# EAGLE board Resistor_Resistor (EAGLE 8.3.0), part 31 of 32
## Placement (x,y rotation side) (continued)
R37923  10K  [0201]  255.78,75.64 0 top
R37924  10K  [0201]  255.78,76.25 0 top
R37925  10K  [0201]  255.78,76.86 0 top
R37926  10K  [0201]  255.78,77.47 0 top
R37927  10K  [0201]  255.78,78.08 0 top
R37928  10K  [0201]  255.78,78.69 0 top
R37929  10K  [0201]  255.78,79.3 0 top
R37930  10K  [0201]  255.78,79.91 0 top
R37931  10K  [0201]  255.78,80.52 0 top
R37932  10K  [0201]  255.78,81.13 0 top
R37933  10K  [0201]  255.78,81.74 0 top
R37934  10K  [0201]  255.78,82.35 0 top
R37935  10K  [0201]  255.78,82.96 0 top
R37936  10K  [0201]  255.78,83.57 0 top
R37937  10K  [0201]  255.78,84.18 0 top
R37938  10K  [0201]  255.78,84.79 0 top
R37939  10K  [0201]  255.78,85.39 0 top
R37940  10K  [0201]  255.78,86 0 top
R37941  10K  [0201]  255.78,86.61 0 top
R37942  10K  [0201]  255.78,87.22 0 top
R37943  10K  [0201]  255.78,87.83 0 top
R37944  10K  [0201]  255.78,88.44 0 top
R37945  10K  [0201]  255.78,89.05 0 top
R37946  10K  [0201]  255.78,89.66 0 top
R37947  10K  [0201]  255.78,90.27 0 top
R37948  10K  [0201]  255.78,90.88 0 top
R37949  10K  [0201]  255.78,91.49 0 top
R37950  10K  [0201]  255.78,92.1 0 top
R37951  10K  [0201]  255.78,92.71 0 top
R37952  10K  [0201]  255.78,93.32 0 top
R37953  10K  [0201]  255.78,93.93 0 top
R37954  10K  [0201]  255.78,94.54 0 top
R37955  10K  [0201]  255.78,95.15 0 top
R37956  10K  [0201]  255.78,95.76 0 top
R37957  10K  [0201]  255.78,96.37 0 top
R37958  10K  [0201]  255.78,96.98 0 top
R37959  10K  [0201]  255.78,97.59 0 top
R37960  10K  [0201]  255.78,98.2 0 top
R37961  10K  [0201]  255.78,98.81 0 top
R37962  10K  [0201]  255.78,99.42 0 top
R37963  10K  [0201]  255.78,100.03 0 top
R37964  10K  [0201]  255.78,100.63 0 top
R37965  10K  [0201]  255.78,101.24 0 top
R37966  10K  [0201]  255.78,101.85 0 top
R37967  10K  [0201]  255.78,102.46 0 top
R37968  10K  [0201]  255.78,103.07 0 top
R37969  10K  [0201]  255.78,103.68 0 top
R37970  10K  [0201]  255.78,104.29 0 top
R37971  10K  [0201]  255.78,104.9 0 top
R37972  10K  [0201]  255.78,105.51 0 top
R37973  10K  [0201]  255.78,106.12 0 top
R37974  10K  [0201]  255.78,106.73 0 top
R37975  10K  [0201]  255.78,107.34 0 top
R37976  10K  [0201]  255.78,107.95 0 top
R37977  10K  [0201]  255.78,108.56 0 top
R37978  10K  [0201]  255.78,109.17 0 top
R37979  10K  [0201]  255.78,109.78 0 top
R37980  10K  [0201]  255.78,110.39 0 top
R37981  10K  [0201]  255.78,111 0 top
R37982  10K  [0201]  255.78,111.61 0 top
R37983  10K  [0201]  255.78,112.22 0 top
R37984  10K  [0201]  255.78,112.83 0 top
R37985  10K  [0201]  255.78,113.44 0 top
R37986  10K  [0201]  255.78,114.05 0 top
R37987  10K  [0201]  255.78,114.66 0 top
R37988  10K  [0201]  255.78,115.27 0 top
R37989  10K  [0201]  255.78,115.87 0 top
R37990  10K  [0201]  255.78,116.48 0 top
R37991  10K  [0201]  255.78,117.09 0 top
R37992  10K  [0201]  255.78,117.7 0 top
R37993  10K  [0201]  255.78,118.31 0 top
R37994  10K  [0201]  255.78,118.92 0 top
R37995  10K  [0201]  255.78,119.53 0 top
R37996  10K  [0201]  255.78,120.14 0 top
R37997  10K  [0201]  255.78,120.75 0 top
R37998  10K  [0201]  255.78,121.36 0 top
R37999  10K  [0201]  255.78,121.97 0 top
R38000  10K  [0201]  255.78,122.58 0 top
R38001  10K  [0201]  257,1.27 0 top
R38002  10K  [0201]  257,1.88 0 top
R38003  10K  [0201]  257,2.49 0 top
R38004  10K  [0201]  257,3.1 0 top
R38005  10K  [0201]  257,3.71 0 top
R38006  10K  [0201]  257,4.32 0 top
R38007  10K  [0201]  257,4.93 0 top
R38008  10K  [0201]  257,5.54 0 top
R38009  10K  [0201]  257,6.15 0 top
R38010  10K  [0201]  257,6.76 0 top
R38011  10K  [0201]  257,7.37 0 top
R38012  10K  [0201]  257,7.98 0 top
R38013  10K  [0201]  257,8.59 0 top
R38014  10K  [0201]  257,9.19 0 top
R38015  10K  [0201]  257,9.8 0 top
R38016  10K  [0201]  257,10.41 0 top
R38017  10K  [0201]  257,11.02 0 top
R38018  10K  [0201]  257,11.63 0 top
R38019  10K  [0201]  257,12.24 0 top
R38020  10K  [0201]  257,12.85 0 top
R38021  10K  [0201]  257,13.46 0 top
R38022  10K  [0201]  257,14.07 0 top
R38023  10K  [0201]  257,14.68 0 top
R38024  10K  [0201]  257,15.29 0 top
R38025  10K  [0201]  257,15.9 0 top
R38026  10K  [0201]  257,16.51 0 top
R38027  10K  [0201]  257,17.12 0 top
R38028  10K  [0201]  257,17.73 0 top
R38029  10K  [0201]  257,18.34 0 top
R38030  10K  [0201]  257,18.95 0 top
R38031  10K  [0201]  257,19.56 0 top
R38032  10K  [0201]  257,20.17 0 top
R38033  10K  [0201]  257,20.78 0 top
R38034  10K  [0201]  257,21.39 0 top
R38035  10K  [0201]  257,22 0 top
R38036  10K  [0201]  257,22.61 0 top
R38037  10K  [0201]  257,23.22 0 top
R38038  10K  [0201]  257,23.83 0 top
R38039  10K  [0201]  257,24.43 0 top
R38040  10K  [0201]  257,25.04 0 top
R38041  10K  [0201]  257,25.65 0 top
R38042  10K  [0201]  257,26.26 0 top
R38043  10K  [0201]  257,26.87 0 top
R38044  10K  [0201]  257,27.48 0 top
R38045  10K  [0201]  257,28.09 0 top
R38046  10K  [0201]  257,28.7 0 top
R38047  10K  [0201]  257,29.31 0 top
R38048  10K  [0201]  257,29.92 0 top
R38049  10K  [0201]  257,30.53 0 top
R38050  10K  [0201]  257,31.14 0 top
R38051  10K  [0201]  257,31.75 0 top
R38052  10K  [0201]  257,32.36 0 top
R38053  10K  [0201]  257,32.97 0 top
R38054  10K  [0201]  257,33.58 0 top
R38055  10K  [0201]  257,34.19 0 top
R38056  10K  [0201]  257,34.8 0 top
R38057  10K  [0201]  257,35.41 0 top
R38058  10K  [0201]  257,36.02 0 top
R38059  10K  [0201]  257,36.63 0 top
R38060  10K  [0201]  257,37.24 0 top
R38061  10K  [0201]  257,37.85 0 top
R38062  10K  [0201]  257,38.46 0 top
R38063  10K  [0201]  257,39.07 0 top
R38064  10K  [0201]  257,39.67 0 top
R38065  10K  [0201]  257,40.28 0 top
R38066  10K  [0201]  257,40.89 0 top
R38067  10K  [0201]  257,41.5 0 top
R38068  10K  [0201]  257,42.11 0 top
R38069  10K  [0201]  257,42.72 0 top
R38070  10K  [0201]  257,43.33 0 top
R38071  10K  [0201]  257,43.94 0 top
R38072  10K  [0201]  257,44.55 0 top
R38073  10K  [0201]  257,45.16 0 top
R38074  10K  [0201]  257,45.77 0 top
R38075  10K  [0201]  257,46.38 0 top
R38076  10K  [0201]  257,46.99 0 top
R38077  10K  [0201]  257,47.6 0 top
R38078  10K  [0201]  257,48.21 0 top
R38079  10K  [0201]  257,48.82 0 top
R38080  10K  [0201]  257,49.43 0 top
R38081  10K  [0201]  257,50.04 0 top
R38082  10K  [0201]  257,50.65 0 top
R38083  10K  [0201]  257,51.26 0 top
R38084  10K  [0201]  257,51.87 0 top
R38085  10K  [0201]  257,52.48 0 top
R38086  10K  [0201]  257,53.09 0 top
R38087  10K  [0201]  257,53.7 0 top
R38088  10K  [0201]  257,54.31 0 top
R38089  10K  [0201]  257,54.91 0 top
R38090  10K  [0201]  257,55.52 0 top
R38091  10K  [0201]  257,56.13 0 top
R38092  10K  [0201]  257,56.74 0 top
R38093  10K  [0201]  257,57.35 0 top
R38094  10K  [0201]  257,57.96 0 top
R38095  10K  [0201]  257,58.57 0 top
R38096  10K  [0201]  257,59.18 0 top
R38097  10K  [0201]  257,59.79 0 top
R38098  10K  [0201]  257,60.4 0 top
R38099  10K  [0201]  257,61.01 0 top
R38100  10K  [0201]  257,61.62 0 top
R38101  10K  [0201]  257,62.23 0 top
R38102  10K  [0201]  257,62.84 0 top
R38103  10K  [0201]  257,63.45 0 top
R38104  10K  [0201]  257,64.06 0 top
R38105  10K  [0201]  257,64.67 0 top
R38106  10K  [0201]  257,65.28 0 top
R38107  10K  [0201]  257,65.89 0 top
R38108  10K  [0201]  257,66.5 0 top
R38109  10K  [0201]  257,67.11 0 top
R38110  10K  [0201]  257,67.72 0 top
R38111  10K  [0201]  257,68.33 0 top
R38112  10K  [0201]  257,68.94 0 top
R38113  10K  [0201]  257,69.55 0 top
R38114  10K  [0201]  257,70.15 0 top
R38115  10K  [0201]  257,70.76 0 top
R38116  10K  [0201]  257,71.37 0 top
R38117  10K  [0201]  257,71.98 0 top
R38118  10K  [0201]  257,72.59 0 top
R38119  10K  [0201]  257,73.2 0 top
R38120  10K  [0201]  257,73.81 0 top
R38121  10K  [0201]  257,74.42 0 top
R38122  10K  [0201]  257,75.03 0 top
R38123  10K  [0201]  257,75.64 0 top
R38124  10K  [0201]  257,76.25 0 top
R38125  10K  [0201]  257,76.86 0 top
R38126  10K  [0201]  257,77.47 0 top
R38127  10K  [0201]  257,78.08 0 top
R38128  10K  [0201]  257,78.69 0 top
R38129  10K  [0201]  257,79.3 0 top
R38130  10K  [0201]  257,79.91 0 top
R38131  10K  [0201]  257,80.52 0 top
R38132  10K  [0201]  257,81.13 0 top
R38133  10K  [0201]  257,81.74 0 top
R38134  10K  [0201]  257,82.35 0 top
R38135  10K  [0201]  257,82.96 0 top
R38136  10K  [0201]  257,83.57 0 top
R38137  10K  [0201]  257,84.18 0 top
R38138  10K  [0201]  257,84.79 0 top
R38139  10K  [0201]  257,85.39 0 top
R38140  10K  [0201]  257,86 0 top
R38141  10K  [0201]  257,86.61 0 top
R38142  10K  [0201]  257,87.22 0 top
R38143  10K  [0201]  257,87.83 0 top
R38144  10K  [0201]  257,88.44 0 top
R38145  10K  [0201]  257,89.05 0 top
R38146  10K  [0201]  257,89.66 0 top
R38147  10K  [0201]  257,90.27 0 top
R38148  10K  [0201]  257,90.88 0 top
R38149  10K  [0201]  257,91.49 0 top
R38150  10K  [0201]  257,92.1 0 top
R38151  10K  [0201]  257,92.71 0 top
R38152  10K  [0201]  257,93.32 0 top
R38153  10K  [0201]  257,93.93 0 top
R38154  10K  [0201]  257,94.54 0 top
R38155  10K  [0201]  257,95.15 0 top
R38156  10K  [0201]  257,95.76 0 top
R38157  10K  [0201]  257,96.37 0 top
R38158  10K  [0201]  257,96.98 0 top
R38159  10K  [0201]  257,97.59 0 top
R38160  10K  [0201]  257,98.2 0 top
R38161  10K  [0201]  257,98.81 0 top
R38162  10K  [0201]  257,99.42 0 top
R38163  10K  [0201]  257,100.03 0 top
R38164  10K  [0201]  257,100.63 0 top
R38165  10K  [0201]  257,101.24 0 top
R38166  10K  [0201]  257,101.85 0 top
R38167  10K  [0201]  257,102.46 0 top
R38168  10K  [0201]  257,103.07 0 top
R38169  10K  [0201]  257,103.68 0 top
R38170  10K  [0201]  257,104.29 0 top
R38171  10K  [0201]  257,104.9 0 top
R38172  10K  [0201]  257,105.51 0 top
R38173  10K  [0201]  257,106.12 0 top
R38174  10K  [0201]  257,106.73 0 top
R38175  10K  [0201]  257,107.34 0 top
R38176  10K  [0201]  257,107.95 0 top
R38177  10K  [0201]  257,108.56 0 top
R38178  10K  [0201]  257,109.17 0 top
R38179  10K  [0201]  257,109.78 0 top
R38180  10K  [0201]  257,110.39 0 top
R38181  10K  [0201]  257,111 0 top
R38182  10K  [0201]  257,111.61 0 top
R38183  10K  [0201]  257,112.22 0 top
R38184  10K  [0201]  257,112.83 0 top
R38185  10K  [0201]  257,113.44 0 top
R38186  10K  [0201]  257,114.05 0 top
R38187  10K  [0201]  257,114.66 0 top
R38188  10K  [0201]  257,115.27 0 top
R38189  10K  [0201]  257,115.87 0 top
R38190  10K  [0201]  257,116.48 0 top
R38191  10K  [0201]  257,117.09 0 top
R38192  10K  [0201]  257,117.7 0 top
R38193  10K  [0201]  257,118.31 0 top
R38194  10K  [0201]  257,118.92 0 top
R38195  10K  [0201]  257,119.53 0 top
R38196  10K  [0201]  257,120.14 0 top
R38197  10K  [0201]  257,120.75 0 top
R38198  10K  [0201]  257,121.36 0 top
R38199  10K  [0201]  257,121.97 0 top
R38200  10K  [0201]  257,122.58 0 top
R38201  10K  [0201]  258.22,1.27 0 top
R38202  10K  [0201]  258.22,1.88 0 top
R38203  10K  [0201]  258.22,2.49 0 top
R38204  10K  [0201]  258.22,3.1 0 top
R38205  10K  [0201]  258.22,3.71 0 top
R38206  10K  [0201]  258.22,4.32 0 top
R38207  10K  [0201]  258.22,4.93 0 top
R38208  10K  [0201]  258.22,5.54 0 top
R38209  10K  [0201]  258.22,6.15 0 top
R38210  10K  [0201]  258.22,6.76 0 top
R38211  10K  [0201]  258.22,7.37 0 top
R38212  10K  [0201]  258.22,7.98 0 top
R38213  10K  [0201]  258.22,8.59 0 top
R38214  10K  [0201]  258.22,9.19 0 top
R38215  10K  [0201]  258.22,9.8 0 top
R38216  10K  [0201]  258.22,10.41 0 top
R38217  10K  [0201]  258.22,11.02 0 top
R38218  10K  [0201]  258.22,11.63 0 top
R38219  10K  [0201]  258.22,12.24 0 top
R38220  10K  [0201]  258.22,12.85 0 top
R38221  10K  [0201]  258.22,13.46 0 top
R38222  10K  [0201]  258.22,14.07 0 top
R38223  10K  [0201]  258.22,14.68 0 top
R38224  10K  [0201]  258.22,15.29 0 top
R38225  10K  [0201]  258.22,15.9 0 top
R38226  10K  [0201]  258.22,16.51 0 top
R38227  10K  [0201]  258.22,17.12 0 top
R38228  10K  [0201]  258.22,17.73 0 top
R38229  10K  [0201]  258.22,18.34 0 top
R38230  10K  [0201]  258.22,18.95 0 top
R38231  10K  [0201]  258.22,19.56 0 top
R38232  10K  [0201]  258.22,20.17 0 top
R38233  10K  [0201]  258.22,20.78 0 top
R38234  10K  [0201]  258.22,21.39 0 top
R38235  10K  [0201]  258.22,22 0 top
R38236  10K  [0201]  258.22,22.61 0 top
R38237  10K  [0201]  258.22,23.22 0 top
R38238  10K  [0201]  258.22,23.83 0 top
R38239  10K  [0201]  258.22,24.43 0 top
R38240  10K  [0201]  258.22,25.04 0 top
R38241  10K  [0201]  258.22,25.65 0 top
R38242  10K  [0201]  258.22,26.26 0 top
R38243  10K  [0201]  258.22,26.87 0 top
R38244  10K  [0201]  258.22,27.48 0 top
R38245  10K  [0201]  258.22,28.09 0 top
R38246  10K  [0201]  258.22,28.7 0 top
R38247  10K  [0201]  258.22,29.31 0 top
R38248  10K  [0201]  258.22,29.92 0 top
R38249  10K  [0201]  258.22,30.53 0 top
R38250  10K  [0201]  258.22,31.14 0 top
R38251  10K  [0201]  258.22,31.75 0 top
R38252  10K  [0201]  258.22,32.36 0 top
R38253  10K  [0201]  258.22,32.97 0 top
R38254  10K  [0201]  258.22,33.58 0 top
R38255  10K  [0201]  258.22,34.19 0 top
R38256  10K  [0201]  258.22,34.8 0 top
R38257  10K  [0201]  258.22,35.41 0 top
R38258  10K  [0201]  258.22,36.02 0 top
R38259  10K  [0201]  258.22,36.63 0 top
R38260  10K  [0201]  258.22,37.24 0 top
R38261  10K  [0201]  258.22,37.85 0 top
R38262  10K  [0201]  258.22,38.46 0 top
R38263  10K  [0201]  258.22,39.07 0 top
R38264  10K  [0201]  258.22,39.67 0 top
R38265  10K  [0201]  258.22,40.28 0 top
R38266  10K  [0201]  258.22,40.89 0 top
R38267  10K  [0201]  258.22,41.5 0 top
R38268  10K  [0201]  258.22,42.11 0 top
R38269  10K  [0201]  258.22,42.72 0 top
R38270  10K  [0201]  258.22,43.33 0 top
R38271  10K  [0201]  258.22,43.94 0 top
R38272  10K  [0201]  258.22,44.55 0 top
R38273  10K  [0201]  258.22,45.16 0 top
R38274  10K  [0201]  258.22,45.77 0 top
R38275  10K  [0201]  258.22,46.38 0 top
R38276  10K  [0201]  258.22,46.99 0 top
R38277  10K  [0201]  258.22,47.6 0 top
R38278  10K  [0201]  258.22,48.21 0 top
R38279  10K  [0201]  258.22,48.82 0 top
R38280  10K  [0201]  258.22,49.43 0 top
R38281  10K  [0201]  258.22,50.04 0 top
R38282  10K  [0201]  258.22,50.65 0 top
R38283  10K  [0201]  258.22,51.26 0 top
R38284  10K  [0201]  258.22,51.87 0 top
R38285  10K  [0201]  258.22,52.48 0 top
R38286  10K  [0201]  258.22,53.09 0 top
R38287  10K  [0201]  258.22,53.7 0 top
R38288  10K  [0201]  258.22,54.31 0 top
R38289  10K  [0201]  258.22,54.91 0 top
R38290  10K  [0201]  258.22,55.52 0 top
R38291  10K  [0201]  258.22,56.13 0 top
R38292  10K  [0201]  258.22,56.74 0 top
R38293  10K  [0201]  258.22,57.35 0 top
R38294  10K  [0201]  258.22,57.96 0 top
R38295  10K  [0201]  258.22,58.57 0 top
R38296  10K  [0201]  258.22,59.18 0 top
R38297  10K  [0201]  258.22,59.79 0 top
R38298  10K  [0201]  258.22,60.4 0 top
R38299  10K  [0201]  258.22,61.01 0 top
R38300  10K  [0201]  258.22,61.62 0 top
R38301  10K  [0201]  258.22,62.23 0 top
R38302  10K  [0201]  258.22,62.84 0 top
R38303  10K  [0201]  258.22,63.45 0 top
R38304  10K  [0201]  258.22,64.06 0 top
R38305  10K  [0201]  258.22,64.67 0 top
R38306  10K  [0201]  258.22,65.28 0 top
R38307  10K  [0201]  258.22,65.89 0 top
R38308  10K  [0201]  258.22,66.5 0 top
R38309  10K  [0201]  258.22,67.11 0 top
R38310  10K  [0201]  258.22,67.72 0 top
R38311  10K  [0201]  258.22,68.33 0 top
R38312  10K  [0201]  258.22,68.94 0 top
R38313  10K  [0201]  258.22,69.55 0 top
R38314  10K  [0201]  258.22,70.15 0 top
R38315  10K  [0201]  258.22,70.76 0 top
R38316  10K  [0201]  258.22,71.37 0 top
R38317  10K  [0201]  258.22,71.98 0 top
R38318  10K  [0201]  258.22,72.59 0 top
R38319  10K  [0201]  258.22,73.2 0 top
R38320  10K  [0201]  258.22,73.81 0 top
R38321  10K  [0201]  258.22,74.42 0 top
R38322  10K  [0201]  258.22,75.03 0 top
R38323  10K  [0201]  258.22,75.64 0 top
R38324  10K  [0201]  258.22,76.25 0 top
R38325  10K  [0201]  258.22,76.86 0 top
R38326  10K  [0201]  258.22,77.47 0 top
R38327  10K  [0201]  258.22,78.08 0 top
R38328  10K  [0201]  258.22,78.69 0 top
R38329  10K  [0201]  258.22,79.3 0 top
R38330  10K  [0201]  258.22,79.91 0 top
R38331  10K  [0201]  258.22,80.52 0 top
R38332  10K  [0201]  258.22,81.13 0 top
R38333  10K  [0201]  258.22,81.74 0 top
R38334  10K  [0201]  258.22,82.35 0 top
R38335  10K  [0201]  258.22,82.96 0 top
R38336  10K  [0201]  258.22,83.57 0 top
R38337  10K  [0201]  258.22,84.18 0 top
R38338  10K  [0201]  258.22,84.79 0 top
R38339  10K  [0201]  258.22,85.39 0 top
R38340  10K  [0201]  258.22,86 0 top
R38341  10K  [0201]  258.22,86.61 0 top
R38342  10K  [0201]  258.22,87.22 0 top
R38343  10K  [0201]  258.22,87.83 0 top
R38344  10K  [0201]  258.22,88.44 0 top
R38345  10K  [0201]  258.22,89.05 0 top
R38346  10K  [0201]  258.22,89.66 0 top
R38347  10K  [0201]  258.22,90.27 0 top
R38348  10K  [0201]  258.22,90.88 0 top
R38349  10K  [0201]  258.22,91.49 0 top
R38350  10K  [0201]  258.22,92.1 0 top
R38351  10K  [0201]  258.22,92.71 0 top
R38352  10K  [0201]  258.22,93.32 0 top
R38353  10K  [0201]  258.22,93.93 0 top
R38354  10K  [0201]  258.22,94.54 0 top
R38355  10K  [0201]  258.22,95.15 0 top
R38356  10K  [0201]  258.22,95.76 0 top
R38357  10K  [0201]  258.22,96.37 0 top
R38358  10K  [0201]  258.22,96.98 0 top
R38359  10K  [0201]  258.22,97.59 0 top
R38360  10K  [0201]  258.22,98.2 0 top
R38361  10K  [0201]  258.22,98.81 0 top
R38362  10K  [0201]  258.22,99.42 0 top
R38363  10K  [0201]  258.22,100.03 0 top
R38364  10K  [0201]  258.22,100.63 0 top
R38365  10K  [0201]  258.22,101.24 0 top
R38366  10K  [0201]  258.22,101.85 0 top
R38367  10K  [0201]  258.22,102.46 0 top
R38368  10K  [0201]  258.22,103.07 0 top
R38369  10K  [0201]  258.22,103.68 0 top
R38370  10K  [0201]  258.22,104.29 0 top
R38371  10K  [0201]  258.22,104.9 0 top
R38372  10K  [0201]  258.22,105.51 0 top
R38373  10K  [0201]  258.22,106.12 0 top
R38374  10K  [0201]  258.22,106.73 0 top
R38375  10K  [0201]  258.22,107.34 0 top
R38376  10K  [0201]  258.22,107.95 0 top
R38377  10K  [0201]  258.22,108.56 0 top
R38378  10K  [0201]  258.22,109.17 0 top
R38379  10K  [0201]  258.22,109.78 0 top
R38380  10K  [0201]  258.22,110.39 0 top
R38381  10K  [0201]  258.22,111 0 top
R38382  10K  [0201]  258.22,111.61 0 top
R38383  10K  [0201]  258.22,112.22 0 top
R38384  10K  [0201]  258.22,112.83 0 top
R38385  10K  [0201]  258.22,113.44 0 top
R38386  10K  [0201]  258.22,114.05 0 top
R38387  10K  [0201]  258.22,114.66 0 top
R38388  10K  [0201]  258.22,115.27 0 top
R38389  10K  [0201]  258.22,115.87 0 top
R38390  10K  [0201]  258.22,116.48 0 top
R38391  10K  [0201]  258.22,117.09 0 top
R38392  10K  [0201]  258.22,117.7 0 top
R38393  10K  [0201]  258.22,118.31 0 top
R38394  10K  [0201]  258.22,118.92 0 top
R38395  10K  [0201]  258.22,119.53 0 top
R38396  10K  [0201]  258.22,120.14 0 top
R38397  10K  [0201]  258.22,120.75 0 top
R38398  10K  [0201]  258.22,121.36 0 top
R38399  10K  [0201]  258.22,121.97 0 top
R38400  10K  [0201]  258.22,122.58 0 top
R38401  10K  [0201]  259.44,1.27 0 top
R38402  10K  [0201]  259.44,1.88 0 top
R38403  10K  [0201]  259.44,2.49 0 top
R38404  10K  [0201]  259.44,3.1 0 top
R38405  10K  [0201]  259.44,3.71 0 top
R38406  10K  [0201]  259.44,4.32 0 top
R38407  10K  [0201]  259.44,4.93 0 top
R38408  10K  [0201]  259.44,5.54 0 top
R38409  10K  [0201]  259.44,6.15 0 top
R38410  10K  [0201]  259.44,6.76 0 top
R38411  10K  [0201]  259.44,7.37 0 top
R38412  10K  [0201]  259.44,7.98 0 top
R38413  10K  [0201]  259.44,8.59 0 top
R38414  10K  [0201]  259.44,9.19 0 top
R38415  10K  [0201]  259.44,9.8 0 top
R38416  10K  [0201]  259.44,10.41 0 top
R38417  10K  [0201]  259.44,11.02 0 top
R38418  10K  [0201]  259.44,11.63 0 top
R38419  10K  [0201]  259.44,12.24 0 top
R38420  10K  [0201]  259.44,12.85 0 top
R38421  10K  [0201]  259.44,13.46 0 top
R38422  10K  [0201]  259.44,14.07 0 top
R38423  10K  [0201]  259.44,14.68 0 top
R38424  10K  [0201]  259.44,15.29 0 top
R38425  10K  [0201]  259.44,15.9 0 top
R38426  10K  [0201]  259.44,16.51 0 top
R38427  10K  [0201]  259.44,17.12 0 top
R38428  10K  [0201]  259.44,17.73 0 top
R38429  10K  [0201]  259.44,18.34 0 top
R38430  10K  [0201]  259.44,18.95 0 top
R38431  10K  [0201]  259.44,19.56 0 top
R38432  10K  [0201]  259.44,20.17 0 top
R38433  10K  [0201]  259.44,20.78 0 top
R38434  10K  [0201]  259.44,21.39 0 top
R38435  10K  [0201]  259.44,22 0 top
R38436  10K  [0201]  259.44,22.61 0 top
R38437  10K  [0201]  259.44,23.22 0 top
R38438  10K  [0201]  259.44,23.83 0 top
R38439  10K  [0201]  259.44,24.43 0 top
R38440  10K  [0201]  259.44,25.04 0 top
R38441  10K  [0201]  259.44,25.65 0 top
R38442  10K  [0201]  259.44,26.26 0 top
R38443  10K  [0201]  259.44,26.87 0 top
R38444  10K  [0201]  259.44,27.48 0 top
R38445  10K  [0201]  259.44,28.09 0 top
R38446  10K  [0201]  259.44,28.7 0 top
R38447  10K  [0201]  259.44,29.31 0 top
R38448  10K  [0201]  259.44,29.92 0 top
R38449  10K  [0201]  259.44,30.53 0 top
R38450  10K  [0201]  259.44,31.14 0 top
R38451  10K  [0201]  259.44,31.75 0 top
R38452  10K  [0201]  259.44,32.36 0 top
R38453  10K  [0201]  259.44,32.97 0 top
R38454  10K  [0201]  259.44,33.58 0 top
R38455  10K  [0201]  259.44,34.19 0 top
R38456  10K  [0201]  259.44,34.8 0 top
R38457  10K  [0201]  259.44,35.41 0 top
R38458  10K  [0201]  259.44,36.02 0 top
R38459  10K  [0201]  259.44,36.63 0 top
R38460  10K  [0201]  259.44,37.24 0 top
R38461  10K  [0201]  259.44,37.85 0 top
R38462  10K  [0201]  259.44,38.46 0 top
R38463  10K  [0201]  259.44,39.07 0 top
R38464  10K  [0201]  259.44,39.67 0 top
R38465  10K  [0201]  259.44,40.28 0 top
R38466  10K  [0201]  259.44,40.89 0 top
R38467  10K  [0201]  259.44,41.5 0 top
R38468  10K  [0201]  259.44,42.11 0 top
R38469  10K  [0201]  259.44,42.72 0 top
R38470  10K  [0201]  259.44,43.33 0 top
R38471  10K  [0201]  259.44,43.94 0 top
R38472  10K  [0201]  259.44,44.55 0 top
R38473  10K  [0201]  259.44,45.16 0 top
R38474  10K  [0201]  259.44,45.77 0 top
R38475  10K  [0201]  259.44,46.38 0 top
R38476  10K  [0201]  259.44,46.99 0 top
R38477  10K  [0201]  259.44,47.6 0 top
R38478  10K  [0201]  259.44,48.21 0 top
R38479  10K  [0201]  259.44,48.82 0 top
R38480  10K  [0201]  259.44,49.43 0 top
R38481  10K  [0201]  259.44,50.04 0 top
R38482  10K  [0201]  259.44,50.65 0 top
R38483  10K  [0201]  259.44,51.26 0 top
R38484  10K  [0201]  259.44,51.87 0 top
R38485  10K  [0201]  259.44,52.48 0 top
R38486  10K  [0201]  259.44,53.09 0 top
R38487  10K  [0201]  259.44,53.7 0 top
R38488  10K  [0201]  259.44,54.31 0 top
R38489  10K  [0201]  259.44,54.91 0 top
R38490  10K  [0201]  259.44,55.52 0 top
R38491  10K  [0201]  259.44,56.13 0 top
R38492  10K  [0201]  259.44,56.74 0 top
R38493  10K  [0201]  259.44,57.35 0 top
R38494  10K  [0201]  259.44,57.96 0 top
R38495  10K  [0201]  259.44,58.57 0 top
R38496  10K  [0201]  259.44,59.18 0 top
R38497  10K  [0201]  259.44,59.79 0 top
R38498  10K  [0201]  259.44,60.4 0 top
R38499  10K  [0201]  259.44,61.01 0 top
R38500  10K  [0201]  259.44,61.62 0 top
R38501  10K  [0201]  259.44,62.23 0 top
R38502  10K  [0201]  259.44,62.84 0 top
R38503  10K  [0201]  259.44,63.45 0 top
R38504  10K  [0201]  259.44,64.06 0 top
R38505  10K  [0201]  259.44,64.67 0 top
R38506  10K  [0201]  259.44,65.28 0 top
R38507  10K  [0201]  259.44,65.89 0 top
R38508  10K  [0201]  259.44,66.5 0 top
R38509  10K  [0201]  259.44,67.11 0 top
R38510  10K  [0201]  259.44,67.72 0 top
R38511  10K  [0201]  259.44,68.33 0 top
R38512  10K  [0201]  259.44,68.94 0 top
R38513  10K  [0201]  259.44,69.55 0 top
R38514  10K  [0201]  259.44,70.15 0 top
R38515  10K  [0201]  259.44,70.76 0 top
R38516  10K  [0201]  259.44,71.37 0 top
R38517  10K  [0201]  259.44,71.98 0 top
R38518  10K  [0201]  259.44,72.59 0 top
R38519  10K  [0201]  259.44,73.2 0 top
R38520  10K  [0201]  259.44,73.81 0 top
R38521  10K  [0201]  259.44,74.42 0 top
R38522  10K  [0201]  259.44,75.03 0 top
R38523  10K  [0201]  259.44,75.64 0 top
R38524  10K  [0201]  259.44,76.25 0 top
R38525  10K  [0201]  259.44,76.86 0 top
R38526  10K  [0201]  259.44,77.47 0 top
R38527  10K  [0201]  259.44,78.08 0 top
R38528  10K  [0201]  259.44,78.69 0 top
R38529  10K  [0201]  259.44,79.3 0 top
R38530  10K  [0201]  259.44,79.91 0 top
R38531  10K  [0201]  259.44,80.52 0 top
R38532  10K  [0201]  259.44,81.13 0 top
R38533  10K  [0201]  259.44,81.74 0 top
R38534  10K  [0201]  259.44,82.35 0 top
R38535  10K  [0201]  259.44,82.96 0 top
R38536  10K  [0201]  259.44,83.57 0 top
R38537  10K  [0201]  259.44,84.18 0 top
R38538  10K  [0201]  259.44,84.79 0 top
R38539  10K  [0201]  259.44,85.39 0 top
R38540  10K  [0201]  259.44,86 0 top
R38541  10K  [0201]  259.44,86.61 0 top
R38542  10K  [0201]  259.44,87.22 0 top
R38543  10K  [0201]  259.44,87.83 0 top
R38544  10K  [0201]  259.44,88.44 0 top
R38545  10K  [0201]  259.44,89.05 0 top
R38546  10K  [0201]  259.44,89.66 0 top
R38547  10K  [0201]  259.44,90.27 0 top
R38548  10K  [0201]  259.44,90.88 0 top
R38549  10K  [0201]  259.44,91.49 0 top
R38550  10K  [0201]  259.44,92.1 0 top
R38551  10K  [0201]  259.44,92.71 0 top
R38552  10K  [0201]  259.44,93.32 0 top
R38553  10K  [0201]  259.44,93.93 0 top
R38554  10K  [0201]  259.44,94.54 0 top
R38555  10K  [0201]  259.44,95.15 0 top
R38556  10K  [0201]  259.44,95.76 0 top
R38557  10K  [0201]  259.44,96.37 0 top
R38558  10K  [0201]  259.44,96.98 0 top
R38559  10K  [0201]  259.44,97.59 0 top
R38560  10K  [0201]  259.44,98.2 0 top
R38561  10K  [0201]  259.44,98.81 0 top
R38562  10K  [0201]  259.44,99.42 0 top
R38563  10K  [0201]  259.44,100.03 0 top
R38564  10K  [0201]  259.44,100.63 0 top
R38565  10K  [0201]  259.44,101.24 0 top
R38566  10K  [0201]  259.44,101.85 0 top
R38567  10K  [0201]  259.44,102.46 0 top
R38568  10K  [0201]  259.44,103.07 0 top
R38569  10K  [0201]  259.44,103.68 0 top
R38570  10K  [0201]  259.44,104.29 0 top
R38571  10K  [0201]  259.44,104.9 0 top
R38572  10K  [0201]  259.44,105.51 0 top
R38573  10K  [0201]  259.44,106.12 0 top
R38574  10K  [0201]  259.44,106.73 0 top
R38575  10K  [0201]  259.44,107.34 0 top
R38576  10K  [0201]  259.44,107.95 0 top
R38577  10K  [0201]  259.44,108.56 0 top
R38578  10K  [0201]  259.44,109.17 0 top
R38579  10K  [0201]  259.44,109.78 0 top
R38580  10K  [0201]  259.44,110.39 0 top
R38581  10K  [0201]  259.44,111 0 top
R38582  10K  [0201]  259.44,111.61 0 top
R38583  10K  [0201]  259.44,112.22 0 top
R38584  10K  [0201]  259.44,112.83 0 top
R38585  10K  [0201]  259.44,113.44 0 top
R38586  10K  [0201]  259.44,114.05 0 top
R38587  10K  [0201]  259.44,114.66 0 top
R38588  10K  [0201]  259.44,115.27 0 top
R38589  10K  [0201]  259.44,115.87 0 top
R38590  10K  [0201]  259.44,116.48 0 top
R38591  10K  [0201]  259.44,117.09 0 top
R38592  10K  [0201]  259.44,117.7 0 top
R38593  10K  [0201]  259.44,118.31 0 top
R38594  10K  [0201]  259.44,118.92 0 top
R38595  10K  [0201]  259.44,119.53 0 top
R38596  10K  [0201]  259.44,120.14 0 top
R38597  10K  [0201]  259.44,120.75 0 top
R38598  10K  [0201]  259.44,121.36 0 top
R38599  10K  [0201]  259.44,121.97 0 top
R38600  10K  [0201]  259.44,122.58 0 top
R38601  10K  [0201]  260.65,1.27 0 top
R38602  10K  [0201]  260.65,1.88 0 top
R38603  10K  [0201]  260.65,2.49 0 top
R38604  10K  [0201]  260.65,3.1 0 top
R38605  10K  [0201]  260.65,3.71 0 top
R38606  10K  [0201]  260.65,4.32 0 top
R38607  10K  [0201]  260.65,4.93 0 top
R38608  10K  [0201]  260.65,5.54 0 top
R38609  10K  [0201]  260.65,6.15 0 top
R38610  10K  [0201]  260.65,6.76 0 top
R38611  10K  [0201]  260.65,7.37 0 top
R38612  10K  [0201]  260.65,7.98 0 top
R38613  10K  [0201]  260.65,8.59 0 top
R38614  10K  [0201]  260.65,9.19 0 top
R38615  10K  [0201]  260.65,9.8 0 top
R38616  10K  [0201]  260.65,10.41 0 top
R38617  10K  [0201]  260.65,11.02 0 top
R38618  10K  [0201]  260.65,11.63 0 top
R38619  10K  [0201]  260.65,12.24 0 top
R38620  10K  [0201]  260.65,12.85 0 top
R38621  10K  [0201]  260.65,13.46 0 top
R38622  10K  [0201]  260.65,14.07 0 top
R38623  10K  [0201]  260.65,14.68 0 top
R38624  10K  [0201]  260.65,15.29 0 top
R38625  10K  [0201]  260.65,15.9 0 top
R38626  10K  [0201]  260.65,16.51 0 top
R38627  10K  [0201]  260.65,17.12 0 top
R38628  10K  [0201]  260.65,17.73 0 top
R38629  10K  [0201]  260.65,18.34 0 top
R38630  10K  [0201]  260.65,18.95 0 top
R38631  10K  [0201]  260.65,19.56 0 top
R38632  10K  [0201]  260.65,20.17 0 top
R38633  10K  [0201]  260.65,20.78 0 top
R38634  10K  [0201]  260.65,21.39 0 top
R38635  10K  [0201]  260.65,22 0 top
R38636  10K  [0201]  260.65,22.61 0 top
R38637  10K  [0201]  260.65,23.22 0 top
R38638  10K  [0201]  260.65,23.83 0 top
R38639  10K  [0201]  260.65,24.43 0 top
R38640  10K  [0201]  260.65,25.04 0 top
R38641  10K  [0201]  260.65,25.65 0 top
R38642  10K  [0201]  260.65,26.26 0 top
R38643  10K  [0201]  260.65,26.87 0 top
R38644  10K  [0201]  260.65,27.48 0 top
R38645  10K  [0201]  260.65,28.09 0 top
R38646  10K  [0201]  260.65,28.7 0 top
R38647  10K  [0201]  260.65,29.31 0 top
R38648  10K  [0201]  260.65,29.92 0 top
R38649  10K  [0201]  260.65,30.53 0 top
R38650  10K  [0201]  260.65,31.14 0 top
R38651  10K  [0201]  260.65,31.75 0 top
R38652  10K  [0201]  260.65,32.36 0 top
R38653  10K  [0201]  260.65,32.97 0 top
R38654  10K  [0201]  260.65,33.58 0 top
R38655  10K  [0201]  260.65,34.19 0 top
R38656  10K  [0201]  260.65,34.8 0 top
R38657  10K  [0201]  260.65,35.41 0 top
R38658  10K  [0201]  260.65,36.02 0 top
R38659  10K  [0201]  260.65,36.63 0 top
R38660  10K  [0201]  260.65,37.24 0 top
R38661  10K  [0201]  260.65,37.85 0 top
R38662  10K  [0201]  260.65,38.46 0 top
R38663  10K  [0201]  260.65,39.07 0 top
R38664  10K  [0201]  260.65,39.67 0 top
R38665  10K  [0201]  260.65,40.28 0 top
R38666  10K  [0201]  260.65,40.89 0 top
R38667  10K  [0201]  260.65,41.5 0 top
R38668  10K  [0201]  260.65,42.11 0 top
R38669  10K  [0201]  260.65,42.72 0 top
R38670  10K  [0201]  260.65,43.33 0 top
R38671  10K  [0201]  260.65,43.94 0 top
R38672  10K  [0201]  260.65,44.55 0 top
R38673  10K  [0201]  260.65,45.16 0 top
R38674  10K  [0201]  260.65,45.77 0 top
R38675  10K  [0201]  260.65,46.38 0 top
R38676  10K  [0201]  260.65,46.99 0 top
R38677  10K  [0201]  260.65,47.6 0 top
R38678  10K  [0201]  260.65,48.21 0 top
R38679  10K  [0201]  260.65,48.82 0 top
R38680  10K  [0201]  260.65,49.43 0 top
R38681  10K  [0201]  260.65,50.04 0 top
R38682  10K  [0201]  260.65,50.65 0 top
R38683  10K  [0201]  260.65,51.26 0 top
R38684  10K  [0201]  260.65,51.87 0 top
R38685  10K  [0201]  260.65,52.48 0 top
R38686  10K  [0201]  260.65,53.09 0 top
R38687  10K  [0201]  260.65,53.7 0 top
R38688  10K  [0201]  260.65,54.31 0 top
R38689  10K  [0201]  260.65,54.91 0 top
R38690  10K  [0201]  260.65,55.52 0 top
R38691  10K  [0201]  260.65,56.13 0 top
R38692  10K  [0201]  260.65,56.74 0 top
R38693  10K  [0201]  260.65,57.35 0 top
R38694  10K  [0201]  260.65,57.96 0 top
R38695  10K  [0201]  260.65,58.57 0 top
R38696  10K  [0201]  260.65,59.18 0 top
R38697  10K  [0201]  260.65,59.79 0 top
R38698  10K  [0201]  260.65,60.4 0 top
R38699  10K  [0201]  260.65,61.01 0 top
R38700  10K  [0201]  260.65,61.62 0 top
R38701  10K  [0201]  260.65,62.23 0 top
R38702  10K  [0201]  260.65,62.84 0 top
R38703  10K  [0201]  260.65,63.45 0 top
R38704  10K  [0201]  260.65,64.06 0 top
R38705  10K  [0201]  260.65,64.67 0 top
R38706  10K  [0201]  260.65,65.28 0 top
R38707  10K  [0201]  260.65,65.89 0 top
R38708  10K  [0201]  260.65,66.5 0 top
R38709  10K  [0201]  260.65,67.11 0 top
R38710  10K  [0201]  260.65,67.72 0 top
R38711  10K  [0201]  260.65,68.33 0 top
R38712  10K  [0201]  260.65,68.94 0 top
R38713  10K  [0201]  260.65,69.55 0 top
R38714  10K  [0201]  260.65,70.15 0 top
R38715  10K  [0201]  260.65,70.76 0 top
R38716  10K  [0201]  260.65,71.37 0 top
R38717  10K  [0201]  260.65,71.98 0 top
R38718  10K  [0201]  260.65,72.59 0 top
R38719  10K  [0201]  260.65,73.2 0 top
R38720  10K  [0201]  260.65,73.81 0 top
R38721  10K  [0201]  260.65,74.42 0 top
R38722  10K  [0201]  260.65,75.03 0 top
R38723  10K  [0201]  260.65,75.64 0 top
R38724  10K  [0201]  260.65,76.25 0 top
R38725  10K  [0201]  260.65,76.86 0 top
R38726  10K  [0201]  260.65,77.47 0 top
R38727  10K  [0201]  260.65,78.08 0 top
R38728  10K  [0201]  260.65,78.69 0 top
R38729  10K  [0201]  260.65,79.3 0 top
R38730  10K  [0201]  260.65,79.91 0 top
R38731  10K  [0201]  260.65,80.52 0 top
R38732  10K  [0201]  260.65,81.13 0 top
R38733  10K  [0201]  260.65,81.74 0 top
R38734  10K  [0201]  260.65,82.35 0 top
R38735  10K  [0201]  260.65,82.96 0 top
R38736  10K  [0201]  260.65,83.57 0 top
R38737  10K  [0201]  260.65,84.18 0 top
R38738  10K  [0201]  260.65,84.79 0 top
R38739  10K  [0201]  260.65,85.39 0 top
R38740  10K  [0201]  260.65,86 0 top
R38741  10K  [0201]  260.65,86.61 0 top
R38742  10K  [0201]  260.65,87.22 0 top
R38743  10K  [0201]  260.65,87.83 0 top
R38744  10K  [0201]  260.65,88.44 0 top
R38745  10K  [0201]  260.65,89.05 0 top
R38746  10K  [0201]  260.65,89.66 0 top
R38747  10K  [0201]  260.65,90.27 0 top
R38748  10K  [0201]  260.65,90.88 0 top
R38749  10K  [0201]  260.65,91.49 0 top
R38750  10K  [0201]  260.65,92.1 0 top
R38751  10K  [0201]  260.65,92.71 0 top
R38752  10K  [0201]  260.65,93.32 0 top
R38753  10K  [0201]  260.65,93.93 0 top
R38754  10K  [0201]  260.65,94.54 0 top
R38755  10K  [0201]  260.65,95.15 0 top
R38756  10K  [0201]  260.65,95.76 0 top
R38757  10K  [0201]  260.65,96.37 0 top
R38758  10K  [0201]  260.65,96.98 0 top
R38759  10K  [0201]  260.65,97.59 0 top
R38760  10K  [0201]  260.65,98.2 0 top
R38761  10K  [0201]  260.65,98.81 0 top
R38762  10K  [0201]  260.65,99.42 0 top
R38763  10K  [0201]  260.65,100.03 0 top
R38764  10K  [0201]  260.65,100.63 0 top
R38765  10K  [0201]  260.65,101.24 0 top
R38766  10K  [0201]  260.65,101.85 0 top
R38767  10K  [0201]  260.65,102.46 0 top
R38768  10K  [0201]  260.65,103.07 0 top
R38769  10K  [0201]  260.65,103.68 0 top
R38770  10K  [0201]  260.65,104.29 0 top
R38771  10K  [0201]  260.65,104.9 0 top
R38772  10K  [0201]  260.65,105.51 0 top
R38773  10K  [0201]  260.65,106.12 0 top
R38774  10K  [0201]  260.65,106.73 0 top
R38775  10K  [0201]  260.65,107.34 0 top
R38776  10K  [0201]  260.65,107.95 0 top
R38777  10K  [0201]  260.65,108.56 0 top
R38778  10K  [0201]  260.65,109.17 0 top
R38779  10K  [0201]  260.65,109.78 0 top
R38780  10K  [0201]  260.65,110.39 0 top
R38781  10K  [0201]  260.65,111 0 top
R38782  10K  [0201]  260.65,111.61 0 top
R38783  10K  [0201]  260.65,112.22 0 top
R38784  10K  [0201]  260.65,112.83 0 top
R38785  10K  [0201]  260.65,113.44 0 top
R38786  10K  [0201]  260.65,114.05 0 top
R38787  10K  [0201]  260.65,114.66 0 top
R38788  10K  [0201]  260.65,115.27 0 top
R38789  10K  [0201]  260.65,115.87 0 top
R38790  10K  [0201]  260.65,116.48 0 top
R38791  10K  [0201]  260.65,117.09 0 top
R38792  10K  [0201]  260.65,117.7 0 top
R38793  10K  [0201]  260.65,118.31 0 top
R38794  10K  [0201]  260.65,118.92 0 top
R38795  10K  [0201]  260.65,119.53 0 top
R38796  10K  [0201]  260.65,120.14 0 top
R38797  10K  [0201]  260.65,120.75 0 top
R38798  10K  [0201]  260.65,121.36 0 top
R38799  10K  [0201]  260.65,121.97 0 top
R38800  10K  [0201]  260.65,122.58 0 top
R38801  10K  [0201]  261.87,1.27 0 top
R38802  10K  [0201]  261.87,1.88 0 top
R38803  10K  [0201]  261.87,2.49 0 top
R38804  10K  [0201]  261.87,3.1 0 top
R38805  10K  [0201]  261.87,3.71 0 top
R38806  10K  [0201]  261.87,4.32 0 top
R38807  10K  [0201]  261.87,4.93 0 top
R38808  10K  [0201]  261.87,5.54 0 top
R38809  10K  [0201]  261.87,6.15 0 top
R38810  10K  [0201]  261.87,6.76 0 top
R38811  10K  [0201]  261.87,7.37 0 top
R38812  10K  [0201]  261.87,7.98 0 top
R38813  10K  [0201]  261.87,8.59 0 top
R38814  10K  [0201]  261.87,9.19 0 top
R38815  10K  [0201]  261.87,9.8 0 top
R38816  10K  [0201]  261.87,10.41 0 top
R38817  10K  [0201]  261.87,11.02 0 top
R38818  10K  [0201]  261.87,11.63 0 top
R38819  10K  [0201]  261.87,12.24 0 top
R38820  10K  [0201]  261.87,12.85 0 top
R38821  10K  [0201]  261.87,13.46 0 top
R38822  10K  [0201]  261.87,14.07 0 top
R38823  10K  [0201]  261.87,14.68 0 top
R38824  10K  [0201]  261.87,15.29 0 top
R38825  10K  [0201]  261.87,15.9 0 top
R38826  10K  [0201]  261.87,16.51 0 top
R38827  10K  [0201]  261.87,17.12 0 top
R38828  10K  [0201]  261.87,17.73 0 top
R38829  10K  [0201]  261.87,18.34 0 top
R38830  10K  [0201]  261.87,18.95 0 top
R38831  10K  [0201]  261.87,19.56 0 top
R38832  10K  [0201]  261.87,20.17 0 top
R38833  10K  [0201]  261.87,20.78 0 top
R38834  10K  [0201]  261.87,21.39 0 top
R38835  10K  [0201]  261.87,22 0 top
R38836  10K  [0201]  261.87,22.61 0 top
R38837  10K  [0201]  261.87,23.22 0 top
R38838  10K  [0201]  261.87,23.83 0 top
R38839  10K  [0201]  261.87,24.43 0 top
R38840  10K  [0201]  261.87,25.04 0 top
R38841  10K  [0201]  261.87,25.65 0 top
R38842  10K  [0201]  261.87,26.26 0 top
R38843  10K  [0201]  261.87,26.87 0 top
R38844  10K  [0201]  261.87,27.48 0 top
R38845  10K  [0201]  261.87,28.09 0 top
R38846  10K  [0201]  261.87,28.7 0 top
R38847  10K  [0201]  261.87,29.31 0 top
R38848  10K  [0201]  261.87,29.92 0 top
R38849  10K  [0201]  261.87,30.53 0 top
R38850  10K  [0201]  261.87,31.14 0 top
R38851  10K  [0201]  261.87,31.75 0 top
R38852  10K  [0201]  261.87,32.36 0 top
R38853  10K  [0201]  261.87,32.97 0 top
R38854  10K  [0201]  261.87,33.58 0 top
R38855  10K  [0201]  261.87,34.19 0 top
R38856  10K  [0201]  261.87,34.8 0 top
R38857  10K  [0201]  261.87,35.41 0 top
R38858  10K  [0201]  261.87,36.02 0 top
R38859  10K  [0201]  261.87,36.63 0 top
R38860  10K  [0201]  261.87,37.24 0 top
R38861  10K  [0201]  261.87,37.85 0 top
R38862  10K  [0201]  261.87,38.46 0 top
R38863  10K  [0201]  261.87,39.07 0 top
R38864  10K  [0201]  261.87,39.67 0 top
R38865  10K  [0201]  261.87,40.28 0 top
R38866  10K  [0201]  261.87,40.89 0 top
R38867  10K  [0201]  261.87,41.5 0 top
R38868  10K  [0201]  261.87,42.11 0 top
R38869  10K  [0201]  261.87,42.72 0 top
R38870  10K  [0201]  261.87,43.33 0 top
R38871  10K  [0201]  261.87,43.94 0 top
R38872  10K  [0201]  261.87,44.55 0 top
R38873  10K  [0201]  261.87,45.16 0 top
R38874  10K  [0201]  261.87,45.77 0 top
R38875  10K  [0201]  261.87,46.38 0 top
R38876  10K  [0201]  261.87,46.99 0 top
R38877  10K  [0201]  261.87,47.6 0 top
R38878  10K  [0201]  261.87,48.21 0 top
R38879  10K  [0201]  261.87,48.82 0 top
R38880  10K  [0201]  261.87,49.43 0 top
R38881  10K  [0201]  261.87,50.04 0 top
R38882  10K  [0201]  261.87,50.65 0 top
R38883  10K  [0201]  261.87,51.26 0 top
R38884  10K  [0201]  261.87,51.87 0 top
R38885  10K  [0201]  261.87,52.48 0 top
R38886  10K  [0201]  261.87,53.09 0 top
R38887  10K  [0201]  261.87,53.7 0 top
R38888  10K  [0201]  261.87,54.31 0 top
R38889  10K  [0201]  261.87,54.91 0 top
R38890  10K  [0201]  261.87,55.52 0 top
R38891  10K  [0201]  261.87,56.13 0 top
R38892  10K  [0201]  261.87,56.74 0 top
R38893  10K  [0201]  261.87,57.35 0 top
R38894  10K  [0201]  261.87,57.96 0 top
R38895  10K  [0201]  261.87,58.57 0 top
R38896  10K  [0201]  261.87,59.18 0 top
R38897  10K  [0201]  261.87,59.79 0 top
R38898  10K  [0201]  261.87,60.4 0 top
R38899  10K  [0201]  261.87,61.01 0 top
R38900  10K  [0201]  261.87,61.62 0 top
R38901  10K  [0201]  261.87,62.23 0 top
R38902  10K  [0201]  261.87,62.84 0 top
R38903  10K  [0201]  261.87,63.45 0 top
R38904  10K  [0201]  261.87,64.06 0 top
R38905  10K  [0201]  261.87,64.67 0 top
R38906  10K  [0201]  261.87,65.28 0 top
R38907  10K  [0201]  261.87,65.89 0 top
R38908  10K  [0201]  261.87,66.5 0 top
R38909  10K  [0201]  261.87,67.11 0 top
R38910  10K  [0201]  261.87,67.72 0 top
R38911  10K  [0201]  261.87,68.33 0 top
R38912  10K  [0201]  261.87,68.94 0 top
R38913  10K  [0201]  261.87,69.55 0 top
R38914  10K  [0201]  261.87,70.15 0 top
R38915  10K  [0201]  261.87,70.76 0 top
R38916  10K  [0201]  261.87,71.37 0 top
R38917  10K  [0201]  261.87,71.98 0 top
R38918  10K  [0201]  261.87,72.59 0 top
R38919  10K  [0201]  261.87,73.2 0 top
R38920  10K  [0201]  261.87,73.81 0 top
R38921  10K  [0201]  261.87,74.42 0 top
R38922  10K  [0201]  261.87,75.03 0 top
R38923  10K  [0201]  261.87,75.64 0 top
R38924  10K  [0201]  261.87,76.25 0 top
R38925  10K  [0201]  261.87,76.86 0 top
R38926  10K  [0201]  261.87,77.47 0 top
R38927  10K  [0201]  261.87,78.08 0 top
R38928  10K  [0201]  261.87,78.69 0 top
R38929  10K  [0201]  261.87,79.3 0 top
R38930  10K  [0201]  261.87,79.91 0 top
R38931  10K  [0201]  261.87,80.52 0 top
R38932  10K  [0201]  261.87,81.13 0 top
R38933  10K  [0201]  261.87,81.74 0 top
R38934  10K  [0201]  261.87,82.35 0 top
R38935  10K  [0201]  261.87,82.96 0 top
R38936  10K  [0201]  261.87,83.57 0 top
R38937  10K  [0201]  261.87,84.18 0 top
R38938  10K  [0201]  261.87,84.79 0 top
R38939  10K  [0201]  261.87,85.39 0 top
R38940  10K  [0201]  261.87,86 0 top
R38941  10K  [0201]  261.87,86.61 0 top
R38942  10K  [0201]  261.87,87.22 0 top
R38943  10K  [0201]  261.87,87.83 0 top
R38944  10K  [0201]  261.87,88.44 0 top
R38945  10K  [0201]  261.87,89.05 0 top
R38946  10K  [0201]  261.87,89.66 0 top
R38947  10K  [0201]  261.87,90.27 0 top
R38948  10K  [0201]  261.87,90.88 0 top
R38949  10K  [0201]  261.87,91.49 0 top
R38950  10K  [0201]  261.87,92.1 0 top
R38951  10K  [0201]  261.87,92.71 0 top
R38952  10K  [0201]  261.87,93.32 0 top
R38953  10K  [0201]  261.87,93.93 0 top
R38954  10K  [0201]  261.87,94.54 0 top
R38955  10K  [0201]  261.87,95.15 0 top
R38956  10K  [0201]  261.87,95.76 0 top
R38957  10K  [0201]  261.87,96.37 0 top
R38958  10K  [0201]  261.87,96.98 0 top
R38959  10K  [0201]  261.87,97.59 0 top
R38960  10K  [0201]  261.87,98.2 0 top
R38961  10K  [0201]  261.87,98.81 0 top
R38962  10K  [0201]  261.87,99.42 0 top
R38963  10K  [0201]  261.87,100.03 0 top
R38964  10K  [0201]  261.87,100.63 0 top
R38965  10K  [0201]  261.87,101.24 0 top
R38966  10K  [0201]  261.87,101.85 0 top
R38967  10K  [0201]  261.87,102.46 0 top
R38968  10K  [0201]  261.87,103.07 0 top
R38969  10K  [0201]  261.87,103.68 0 top
R38970  10K  [0201]  261.87,104.29 0 top
R38971  10K  [0201]  261.87,104.9 0 top
R38972  10K  [0201]  261.87,105.51 0 top
R38973  10K  [0201]  261.87,106.12 0 top
R38974  10K  [0201]  261.87,106.73 0 top
R38975  10K  [0201]  261.87,107.34 0 top
R38976  10K  [0201]  261.87,107.95 0 top
R38977  10K  [0201]  261.87,108.56 0 top
R38978  10K  [0201]  261.87,109.17 0 top
R38979  10K  [0201]  261.87,109.78 0 top
R38980  10K  [0201]  261.87,110.39 0 top
R38981  10K  [0201]  261.87,111 0 top
R38982  10K  [0201]  261.87,111.61 0 top
R38983  10K  [0201]  261.87,112.22 0 top
R38984  10K  [0201]  261.87,112.83 0 top
R38985  10K  [0201]  261.87,113.44 0 top
R38986  10K  [0201]  261.87,114.05 0 top
R38987  10K  [0201]  261.87,114.66 0 top
R38988  10K  [0201]  261.87,115.27 0 top
R38989  10K  [0201]  261.87,115.87 0 top
R38990  10K  [0201]  261.87,116.48 0 top
R38991  10K  [0201]  261.87,117.09 0 top
R38992  10K  [0201]  261.87,117.7 0 top
R38993  10K  [0201]  261.87,118.31 0 top
R38994  10K  [0201]  261.87,118.92 0 top
R38995  10K  [0201]  261.87,119.53 0 top
R38996  10K  [0201]  261.87,120.14 0 top
R38997  10K  [0201]  261.87,120.75 0 top
R38998  10K  [0201]  261.87,121.36 0 top
R38999  10K  [0201]  261.87,121.97 0 top
R39000  10K  [0201]  261.87,122.58 0 top
R39001  10K  [0201]  263.09,1.27 0 top
R39002  10K  [0201]  263.09,1.88 0 top
R39003  10K  [0201]  263.09,2.49 0 top
R39004  10K  [0201]  263.09,3.1 0 top
R39005  10K  [0201]  263.09,3.71 0 top
R39006  10K  [0201]  263.09,4.32 0 top
R39007  10K  [0201]  263.09,4.93 0 top
R39008  10K  [0201]  263.09,5.54 0 top
R39009  10K  [0201]  263.09,6.15 0 top
R39010  10K  [0201]  263.09,6.76 0 top
R39011  10K  [0201]  263.09,7.37 0 top
R39012  10K  [0201]  263.09,7.98 0 top
R39013  10K  [0201]  263.09,8.59 0 top
R39014  10K  [0201]  263.09,9.19 0 top
R39015  10K  [0201]  263.09,9.8 0 top
R39016  10K  [0201]  263.09,10.41 0 top
R39017  10K  [0201]  263.09,11.02 0 top
R39018  10K  [0201]  263.09,11.63 0 top
R39019  10K  [0201]  263.09,12.24 0 top
R39020  10K  [0201]  263.09,12.85 0 top
R39021  10K  [0201]  263.09,13.46 0 top
R39022  10K  [0201]  263.09,14.07 0 top
R39023  10K  [0201]  263.09,14.68 0 top
R39024  10K  [0201]  263.09,15.29 0 top
R39025  10K  [0201]  263.09,15.9 0 top
R39026  10K  [0201]  263.09,16.51 0 top
R39027  10K  [0201]  263.09,17.12 0 top
R39028  10K  [0201]  263.09,17.73 0 top
R39029  10K  [0201]  263.09,18.34 0 top
R39030  10K  [0201]  263.09,18.95 0 top
R39031  10K  [0201]  263.09,19.56 0 top
R39032  10K  [0201]  263.09,20.17 0 top
R39033  10K  [0201]  263.09,20.78 0 top
R39034  10K  [0201]  263.09,21.39 0 top
R39035  10K  [0201]  263.09,22 0 top
R39036  10K  [0201]  263.09,22.61 0 top
R39037  10K  [0201]  263.09,23.22 0 top
R39038  10K  [0201]  263.09,23.83 0 top
R39039  10K  [0201]  263.09,24.43 0 top
R39040  10K  [0201]  263.09,25.04 0 top
R39041  10K  [0201]  263.09,25.65 0 top
R39042  10K  [0201]  263.09,26.26 0 top
R39043  10K  [0201]  263.09,26.87 0 top
R39044  10K  [0201]  263.09,27.48 0 top
R39045  10K  [0201]  263.09,28.09 0 top
R39046  10K  [0201]  263.09,28.7 0 top
R39047  10K  [0201]  263.09,29.31 0 top
R39048  10K  [0201]  263.09,29.92 0 top
R39049  10K  [0201]  263.09,30.53 0 top
R39050  10K  [0201]  263.09,31.14 0 top
R39051  10K  [0201]  263.09,31.75 0 top
R39052  10K  [0201]  263.09,32.36 0 top
R39053  10K  [0201]  263.09,32.97 0 top
R39054  10K  [0201]  263.09,33.58 0 top
R39055  10K  [0201]  263.09,34.19 0 top
R39056  10K  [0201]  263.09,34.8 0 top
R39057  10K  [0201]  263.09,35.41 0 top
R39058  10K  [0201]  263.09,36.02 0 top
R39059  10K  [0201]  263.09,36.63 0 top
R39060  10K  [0201]  263.09,37.24 0 top
R39061  10K  [0201]  263.09,37.85 0 top
R39062  10K  [0201]  263.09,38.46 0 top
R39063  10K  [0201]  263.09,39.07 0 top
R39064  10K  [0201]  263.09,39.67 0 top
R39065  10K  [0201]  263.09,40.28 0 top
R39066  10K  [0201]  263.09,40.89 0 top
R39067  10K  [0201]  263.09,41.5 0 top
R39068  10K  [0201]  263.09,42.11 0 top
R39069  10K  [0201]  263.09,42.72 0 top
R39070  10K  [0201]  263.09,43.33 0 top
R39071  10K  [0201]  263.09,43.94 0 top
R39072  10K  [0201]  263.09,44.55 0 top
R39073  10K  [0201]  263.09,45.16 0 top
R39074  10K  [0201]  263.09,45.77 0 top
R39075  10K  [0201]  263.09,46.38 0 top
R39076  10K  [0201]  263.09,46.99 0 top
R39077  10K  [0201]  263.09,47.6 0 top
R39078  10K  [0201]  263.09,48.21 0 top
R39079  10K  [0201]  263.09,48.82 0 top
R39080  10K  [0201]  263.09,49.43 0 top
R39081  10K  [0201]  263.09,50.04 0 top
R39082  10K  [0201]  263.09,50.65 0 top
R39083  10K  [0201]  263.09,51.26 0 top
R39084  10K  [0201]  263.09,51.87 0 top
R39085  10K  [0201]  263.09,52.48 0 top
R39086  10K  [0201]  263.09,53.09 0 top
R39087  10K  [0201]  263.09,53.7 0 top
R39088  10K  [0201]  263.09,54.31 0 top
R39089  10K  [0201]  263.09,54.91 0 top
R39090  10K  [0201]  263.09,55.52 0 top
R39091  10K  [0201]  263.09,56.13 0 top
R39092  10K  [0201]  263.09,56.74 0 top
R39093  10K  [0201]  263.09,57.35 0 top
R39094  10K  [0201]  263.09,57.96 0 top
R39095  10K  [0201]  263.09,58.57 0 top
R39096  10K  [0201]  263.09,59.18 0 top
R39097  10K  [0201]  263.09,59.79 0 top
R39098  10K  [0201]  263.09,60.4 0 top
R39099  10K  [0201]  263.09,61.01 0 top
R39100  10K  [0201]  263.09,61.62 0 top
R39101  10K  [0201]  263.09,62.23 0 top
R39102  10K  [0201]  263.09,62.84 0 top
R39103  10K  [0201]  263.09,63.45 0 top
R39104  10K  [0201]  263.09,64.06 0 top
R39105  10K  [0201]  263.09,64.67 0 top
R39106  10K  [0201]  263.09,65.28 0 top
R39107  10K  [0201]  263.09,65.89 0 top
R39108  10K  [0201]  263.09,66.5 0 top
R39109  10K  [0201]  263.09,67.11 0 top
R39110  10K  [0201]  263.09,67.72 0 top
R39111  10K  [0201]  263.09,68.33 0 top
R39112  10K  [0201]  263.09,68.94 0 top
R39113  10K  [0201]  263.09,69.55 0 top
R39114  10K  [0201]  263.09,70.15 0 top
R39115  10K  [0201]  263.09,70.76 0 top
R39116  10K  [0201]  263.09,71.37 0 top
R39117  10K  [0201]  263.09,71.98 0 top
R39118  10K  [0201]  263.09,72.59 0 top
R39119  10K  [0201]  263.09,73.2 0 top
R39120  10K  [0201]  263.09,73.81 0 top
R39121  10K  [0201]  263.09,74.42 0 top
R39122  10K  [0201]  263.09,75.03 0 top
R39123  10K  [0201]  263.09,75.64 0 top
R39124  10K  [0201]  263.09,76.25 0 top
R39125  10K  [0201]  263.09,76.86 0 top
R39126  10K  [0201]  263.09,77.47 0 top
R39127  10K  [0201]  263.09,78.08 0 top
R39128  10K  [0201]  263.09,78.69 0 top
R39129  10K  [0201]  263.09,79.3 0 top
R39130  10K  [0201]  263.09,79.91 0 top
R39131  10K  [0201]  263.09,80.52 0 top
R39132  10K  [0201]  263.09,81.13 0 top
R39133  10K  [0201]  263.09,81.74 0 top
R39134  10K  [0201]  263.09,82.35 0 top
R39135  10K  [0201]  263.09,82.96 0 top
R39136  10K  [0201]  263.09,83.57 0 top
R39137  10K  [0201]  263.09,84.18 0 top
R39138  10K  [0201]  263.09,84.79 0 top
R39139  10K  [0201]  263.09,85.39 0 top
R39140  10K  [0201]  263.09,86 0 top
R39141  10K  [0201]  263.09,86.61 0 top
R39142  10K  [0201]  263.09,87.22 0 top
R39143  10K  [0201]  263.09,87.83 0 top
R39144  10K  [0201]  263.09,88.44 0 top
R39145  10K  [0201]  263.09,89.05 0 top
R39146  10K  [0201]  263.09,89.66 0 top
R39147  10K  [0201]  263.09,90.27 0 top
R39148  10K  [0201]  263.09,90.88 0 top
R39149  10K  [0201]  263.09,91.49 0 top
R39150  10K  [0201]  263.09,92.1 0 top
R39151  10K  [0201]  263.09,92.71 0 top
R39152  10K  [0201]  263.09,93.32 0 top
R39153  10K  [0201]  263.09,93.93 0 top
R39154  10K  [0201]  263.09,94.54 0 top
R39155  10K  [0201]  263.09,95.15 0 top
R39156  10K  [0201]  263.09,95.76 0 top
R39157  10K  [0201]  263.09,96.37 0 top
R39158  10K  [0201]  263.09,96.98 0 top
R39159  10K  [0201]  263.09,97.59 0 top
R39160  10K  [0201]  263.09,98.2 0 top
R39161  10K  [0201]  263.09,98.81 0 top
R39162  10K  [0201]  263.09,99.42 0 top
R39163  10K  [0201]  263.09,100.03 0 top
R39164  10K  [0201]  263.09,100.63 0 top
R39165  10K  [0201]  263.09,101.24 0 top
R39166  10K  [0201]  263.09,101.85 0 top
R39167  10K  [0201]  263.09,102.46 0 top
R39168  10K  [0201]  263.09,103.07 0 top
R39169  10K  [0201]  263.09,103.68 0 top
R39170  10K  [0201]  263.09,104.29 0 top
R39171  10K  [0201]  263.09,104.9 0 top
R39172  10K  [0201]  263.09,105.51 0 top
R39173  10K  [0201]  263.09,106.12 0 top
R39174  10K  [0201]  263.09,106.73 0 top
R39175  10K  [0201]  263.09,107.34 0 top
R39176  10K  [0201]  263.09,107.95 0 top
R39177  10K  [0201]  263.09,108.56 0 top
R39178  10K  [0201]  263.09,109.17 0 top
R39179  10K  [0201]  263.09,109.78 0 top